# Altium schematic sheet SOC_PL_Banks_63_64_65_DDR4.SchDoc: Title
size 420 x 297 mm; Author: G.Kasprowicz; CompanyName: WUT ISE; DrawnBy: G.Kasprowicz; Organization: WUT ISE; Address1: PW ISE; Address2: Nowowiejska 15/19 00-665 Warsaw; Address3: gkasprow@gmail.com; DocumentNumber: 15; Revision: 2; SheetNumber: 15; SheetTotal: 40; ModifiedBy: -; CheckedDate: -; Title2: Title 2; DivGrp: WUT ISE; Designer: G.Kasprowicz; ModifiedDate: -; ProjectName: Sensor Box
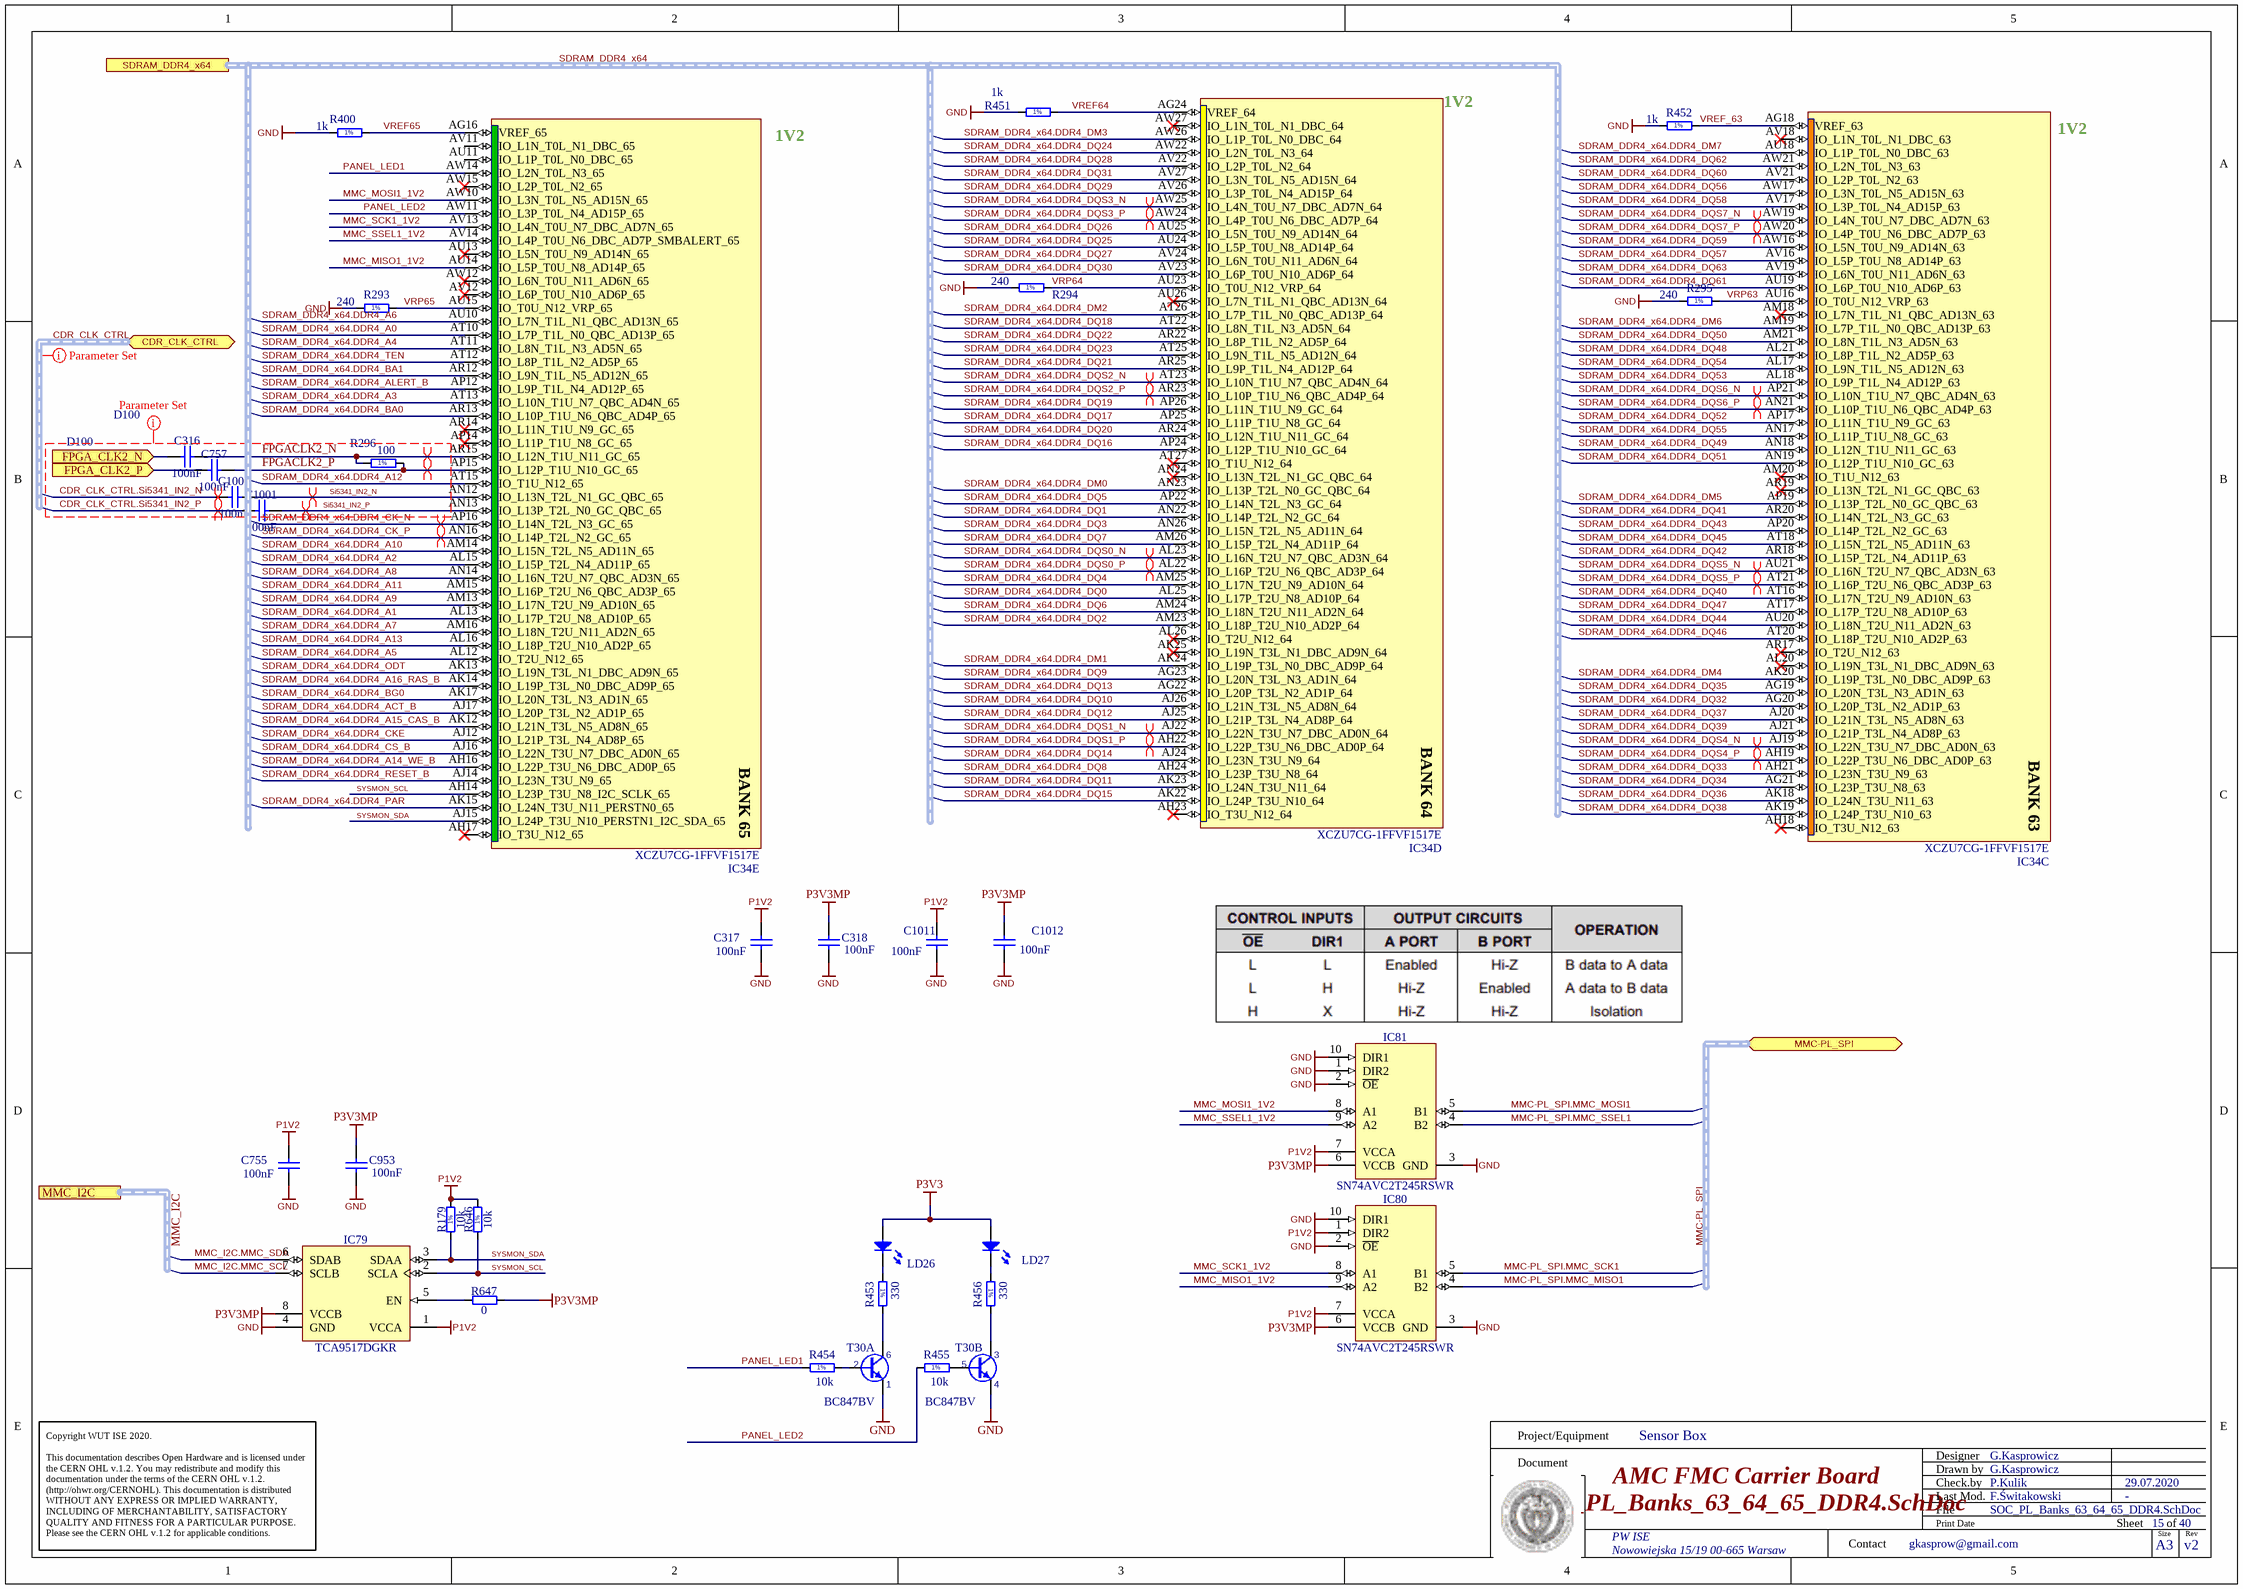
[diagram p0: SOC_PL_Banks_63_64_65_DDR4.SchDoc]

## Parts
C316  100nF  [CAPC0603X33N]
C317  100nF  [CAPC0603X33N]
C318  100nF  [CAPC0603X33N]
C755  100nF  [CAPC0603X33N]
C757  100nF  [CAPC0603X33N]
C953  100nF  [CAPC0603X33N]
C1000  100nF  [CAPC0603X33N]
C1001  100nF  [CAPC0603X33N]
C1011  100nF  [CAPC0603X33N]
C1012  100nF  [CAPC0603X33N]
IC34  XCZU7CG-1FFVF1517E  [BGA1517C100P39X39_4000X4000X351]  (parts C,D,E of 28)
IC79  TCA9517DGKR  [SOP65P490X110-8N]
IC80  SN74AVC2T245RSWR  [QFN40P140X180X55-10N]
IC81  SN74AVC2T245RSWR  [QFN40P140X180X55-10N]
LD26  Green  [LED_AVAGO_HSME-C120]  (value not drawn)
LD27  Green  [LED_AVAGO_HSME-C120]  (value not drawn)
R179  10k  [RESC1005X40N]
R293  240  [RESC1005X40N]
R294  240  [RESC1005X40N]
R295  240  [RESC1005X40N]
R296  100  [RESC1005X40N]
R400  1k  [RESC1005X40N]
R451  1k  [RESC1005X40N]
R452  1k  [RESC1005X40N]
R453  330  [RESC1005X40N]
R454  10k  [RESC1005X40N]
R455  10k  [RESC1005X40N]
R456  330  [RESC1005X40N]
R646  10k  [RESC1005X40N]
R647  0  [RESC1005X40N]
T30  BC847BV  [SOTFL50P160X60-6N]  (parts A,B of 2)

## Ports
CDR_CLK_CTRL (bidir, harness CDR_CLK_CTRL), FPGA_CLK2_N (in), FPGA_CLK2_P (in), MMC-PL_SPI (bidir, harness MMC-PL_SPI), MMC_I2C (harness MMC_I2C), SDRAM_DDR4_x64 (harness SDRAM_DDR4_x64)

## Nets
GND: C317.1 C318.1 C755.1 C953.1 C1011.1 C1012.1 IC79.4(GND) IC80.2(~{OE}) IC80.3(GND) IC80.10(DIR1) IC81.1(DIR2) IC81.2(~{OE}) IC81.3(GND) IC81.10(DIR1) R293.1 R294.1 R295.1 R400.1 R451.1 R452.1 T30.1(E) T30.4(E)
P1V2: C317.2 C755.2 C1011.2 IC79.1(VCCA) IC80.1(DIR2) IC80.7(VCCA) IC81.7(VCCA) R179.2 R646.2
P3V3: LD26.2(A) LD27.2(A)
P3V3MP: C318.2 C953.2 C1012.2 IC79.8(VCCB) IC80.6(VCCB) IC81.6(VCCB) R647.2
CDR_CLK_CTRL.Si5341_IN2_N: C1000.1
CDR_CLK_CTRL.Si5341_IN2_P: C1001.1
FPGA_CLK2_N: C316.1 ; port FPGA_CLK2_N
FPGA_CLK2_P: C757.1 ; port FPGA_CLK2_P
FPGACLK2_N: C316.2 IC34.AR15(IO_L12N_T1U_N11_GC_65) R296.1
FPGACLK2_P: C757.2 IC34.AP15(IO_L12P_T1U_N10_GC_65) R296.2
MMC-PL_SPI.MMC_MISO1: IC80.4(B2)
MMC-PL_SPI.MMC_MOSI1: IC81.5(B1)
MMC-PL_SPI.MMC_SCK1: IC80.5(B1)
MMC-PL_SPI.MMC_SSEL1: IC81.4(B2)
MMC_I2C.MMC_SCL: IC79.7(SCLB)
MMC_I2C.MMC_SDA: IC79.6(SDAB)
MMC_MISO1_1V2: IC34.AU14(IO_L5P_T0U_N8_AD14P_65) IC80.9(A2)
MMC_MOSI1_1V2: IC34.AW10(IO_L3N_T0L_N5_AD15N_65) IC81.8(A1)
MMC_SCK1_1V2: IC34.AV13(IO_L4N_T0U_N7_DBC_AD7N_65) IC80.8(A1)
MMC_SSEL1_1V2: IC34.AV14(IO_L4P_T0U_N6_DBC_AD7P_SMBALERT_65) IC81.9(A2)
PANEL_LED1: IC34.AW14(IO_L2N_T0L_N3_65) R454.1
PANEL_LED2: IC34.AW11(IO_L3P_T0L_N4_AD15P_65) R455.1
SDRAM_DDR4_x64.DDR4_A0: IC34.AT10(IO_L7P_T1L_N0_QBC_AD13P_65)
SDRAM_DDR4_x64.DDR4_A1: IC34.AL13(IO_L17P_T2U_N8_AD10P_65)
SDRAM_DDR4_x64.DDR4_A2: IC34.AL15(IO_L15P_T2L_N4_AD11P_65)
SDRAM_DDR4_x64.DDR4_A3: IC34.AT13(IO_L10N_T1U_N7_QBC_AD4N_65)
SDRAM_DDR4_x64.DDR4_A4: IC34.AT11(IO_L8N_T1L_N3_AD5N_65)
SDRAM_DDR4_x64.DDR4_A5: IC34.AL12(IO_T2U_N12_65)
SDRAM_DDR4_x64.DDR4_A6: IC34.AU10(IO_L7N_T1L_N1_QBC_AD13N_65)
SDRAM_DDR4_x64.DDR4_A7: IC34.AM16(IO_L18N_T2U_N11_AD2N_65)
SDRAM_DDR4_x64.DDR4_A8: IC34.AN14(IO_L16N_T2U_N7_QBC_AD3N_65)
SDRAM_DDR4_x64.DDR4_A9: IC34.AM13(IO_L17N_T2U_N9_AD10N_65)
SDRAM_DDR4_x64.DDR4_A10: IC34.AM14(IO_L15N_T2L_N5_AD11N_65)
SDRAM_DDR4_x64.DDR4_A11: IC34.AM15(IO_L16P_T2U_N6_QBC_AD3P_65)
SDRAM_DDR4_x64.DDR4_A12: IC34.AT15(IO_T1U_N12_65)
SDRAM_DDR4_x64.DDR4_A13: IC34.AL16(IO_L18P_T2U_N10_AD2P_65)
SDRAM_DDR4_x64.DDR4_A14_WE_B: IC34.AH16(IO_L22P_T3U_N6_DBC_AD0P_65)
SDRAM_DDR4_x64.DDR4_A15_CAS_B: IC34.AK12(IO_L21N_T3L_N5_AD8N_65)
SDRAM_DDR4_x64.DDR4_A16_RAS_B: IC34.AK14(IO_L19P_T3L_N0_DBC_AD9P_65)
SDRAM_DDR4_x64.DDR4_ACT_B: IC34.AJ17(IO_L20P_T3L_N2_AD1P_65)
SDRAM_DDR4_x64.DDR4_ALERT_B: IC34.AP12(IO_L9P_T1L_N4_AD12P_65)
SDRAM_DDR4_x64.DDR4_BA0: IC34.AR13(IO_L10P_T1U_N6_QBC_AD4P_65)
SDRAM_DDR4_x64.DDR4_BA1: IC34.AR12(IO_L9N_T1L_N5_AD12N_65)
SDRAM_DDR4_x64.DDR4_BG0: IC34.AK17(IO_L20N_T3L_N3_AD1N_65)
SDRAM_DDR4_x64.DDR4_CK_N: IC34.AP16(IO_L14N_T2L_N3_GC_65)
SDRAM_DDR4_x64.DDR4_CK_P: IC34.AN16(IO_L14P_T2L_N2_GC_65)
SDRAM_DDR4_x64.DDR4_CKE: IC34.AJ12(IO_L21P_T3L_N4_AD8P_65)
SDRAM_DDR4_x64.DDR4_CS_B: IC34.AJ16(IO_L22N_T3U_N7_DBC_AD0N_65)
SDRAM_DDR4_x64.DDR4_DM0: IC34.AN23(IO_L13P_T2L_N0_GC_QBC_64)
SDRAM_DDR4_x64.DDR4_DM1: IC34.AK24(IO_L19P_T3L_N0_DBC_AD9P_64)
SDRAM_DDR4_x64.DDR4_DM2: IC34.AT26(IO_L7P_T1L_N0_QBC_AD13P_64)
SDRAM_DDR4_x64.DDR4_DM3: IC34.AW26(IO_L1P_T0L_N0_DBC_64)
SDRAM_DDR4_x64.DDR4_DM4: IC34.AK20(IO_L19P_T3L_N0_DBC_AD9P_63)
SDRAM_DDR4_x64.DDR4_DM5: IC34.AP19(IO_L13P_T2L_N0_GC_QBC_63)
SDRAM_DDR4_x64.DDR4_DM6: IC34.AM19(IO_L7P_T1L_N0_QBC_AD13P_63)
SDRAM_DDR4_x64.DDR4_DM7: IC34.AU18(IO_L1P_T0L_N0_DBC_63)
SDRAM_DDR4_x64.DDR4_DQ0: IC34.AL25(IO_L17P_T2U_N8_AD10P_64)
SDRAM_DDR4_x64.DDR4_DQ1: IC34.AN22(IO_L14P_T2L_N2_GC_64)
SDRAM_DDR4_x64.DDR4_DQ2: IC34.AM23(IO_L18P_T2U_N10_AD2P_64)
SDRAM_DDR4_x64.DDR4_DQ3: IC34.AN26(IO_L15N_T2L_N5_AD11N_64)
SDRAM_DDR4_x64.DDR4_DQ4: IC34.AM25(IO_L17N_T2U_N9_AD10N_64)
SDRAM_DDR4_x64.DDR4_DQ5: IC34.AP22(IO_L14N_T2L_N3_GC_64)
SDRAM_DDR4_x64.DDR4_DQ6: IC34.AM24(IO_L18N_T2U_N11_AD2N_64)
SDRAM_DDR4_x64.DDR4_DQ7: IC34.AM26(IO_L15P_T2L_N4_AD11P_64)
SDRAM_DDR4_x64.DDR4_DQ8: IC34.AH24(IO_L23P_T3U_N8_64)
SDRAM_DDR4_x64.DDR4_DQ9: IC34.AG23(IO_L20N_T3L_N3_AD1N_64)
SDRAM_DDR4_x64.DDR4_DQ10: IC34.AJ26(IO_L21N_T3L_N5_AD8N_64)
SDRAM_DDR4_x64.DDR4_DQ11: IC34.AK23(IO_L24N_T3U_N11_64)
SDRAM_DDR4_x64.DDR4_DQ12: IC34.AJ25(IO_L21P_T3L_N4_AD8P_64)
SDRAM_DDR4_x64.DDR4_DQ13: IC34.AG22(IO_L20P_T3L_N2_AD1P_64)
SDRAM_DDR4_x64.DDR4_DQ14: IC34.AJ24(IO_L23N_T3U_N9_64)
SDRAM_DDR4_x64.DDR4_DQ15: IC34.AK22(IO_L24P_T3U_N10_64)
SDRAM_DDR4_x64.DDR4_DQ16: IC34.AP24(IO_L12P_T1U_N10_GC_64)
SDRAM_DDR4_x64.DDR4_DQ17: IC34.AP25(IO_L11P_T1U_N8_GC_64)
SDRAM_DDR4_x64.DDR4_DQ18: IC34.AT22(IO_L8N_T1L_N3_AD5N_64)
SDRAM_DDR4_x64.DDR4_DQ19: IC34.AP26(IO_L11N_T1U_N9_GC_64)
SDRAM_DDR4_x64.DDR4_DQ20: IC34.AR24(IO_L12N_T1U_N11_GC_64)
SDRAM_DDR4_x64.DDR4_DQ21: IC34.AR25(IO_L9P_T1L_N4_AD12P_64)
SDRAM_DDR4_x64.DDR4_DQ22: IC34.AR22(IO_L8P_T1L_N2_AD5P_64)
SDRAM_DDR4_x64.DDR4_DQ23: IC34.AT25(IO_L9N_T1L_N5_AD12N_64)
SDRAM_DDR4_x64.DDR4_DQ24: IC34.AW22(IO_L2N_T0L_N3_64)
SDRAM_DDR4_x64.DDR4_DQ25: IC34.AU24(IO_L5P_T0U_N8_AD14P_64)
SDRAM_DDR4_x64.DDR4_DQ26: IC34.AU25(IO_L5N_T0U_N9_AD14N_64)
SDRAM_DDR4_x64.DDR4_DQ27: IC34.AV24(IO_L6N_T0U_N11_AD6N_64)
SDRAM_DDR4_x64.DDR4_DQ28: IC34.AV22(IO_L2P_T0L_N2_64)
SDRAM_DDR4_x64.DDR4_DQ29: IC34.AV26(IO_L3P_T0L_N4_AD15P_64)
SDRAM_DDR4_x64.DDR4_DQ30: IC34.AV23(IO_L6P_T0U_N10_AD6P_64)
SDRAM_DDR4_x64.DDR4_DQ31: IC34.AV27(IO_L3N_T0L_N5_AD15N_64)
SDRAM_DDR4_x64.DDR4_DQ32: IC34.AG20(IO_L20P_T3L_N2_AD1P_63)
SDRAM_DDR4_x64.DDR4_DQ33: IC34.AH21(IO_L23N_T3U_N9_63)
SDRAM_DDR4_x64.DDR4_DQ34: IC34.AG21(IO_L23P_T3U_N8_63)
SDRAM_DDR4_x64.DDR4_DQ35: IC34.AG19(IO_L20N_T3L_N3_AD1N_63)
SDRAM_DDR4_x64.DDR4_DQ36: IC34.AK18(IO_L24N_T3U_N11_63)
SDRAM_DDR4_x64.DDR4_DQ37: IC34.AJ20(IO_L21N_T3L_N5_AD8N_63)
SDRAM_DDR4_x64.DDR4_DQ38: IC34.AK19(IO_L24P_T3U_N10_63)
SDRAM_DDR4_x64.DDR4_DQ39: IC34.AJ21(IO_L21P_T3L_N4_AD8P_63)
SDRAM_DDR4_x64.DDR4_DQ40: IC34.AT16(IO_L17N_T2U_N9_AD10N_63)
SDRAM_DDR4_x64.DDR4_DQ41: IC34.AR20(IO_L14N_T2L_N3_GC_63)
SDRAM_DDR4_x64.DDR4_DQ42: IC34.AR18(IO_L15P_T2L_N4_AD11P_63)
SDRAM_DDR4_x64.DDR4_DQ43: IC34.AP20(IO_L14P_T2L_N2_GC_63)
SDRAM_DDR4_x64.DDR4_DQ44: IC34.AU20(IO_L18N_T2U_N11_AD2N_63)
SDRAM_DDR4_x64.DDR4_DQ45: IC34.AT18(IO_L15N_T2L_N5_AD11N_63)
SDRAM_DDR4_x64.DDR4_DQ46: IC34.AT20(IO_L18P_T2U_N10_AD2P_63)
SDRAM_DDR4_x64.DDR4_DQ47: IC34.AT17(IO_L17P_T2U_N8_AD10P_63)
SDRAM_DDR4_x64.DDR4_DQ48: IC34.AL21(IO_L8P_T1L_N2_AD5P_63)
SDRAM_DDR4_x64.DDR4_DQ49: IC34.AN18(IO_L12N_T1U_N11_GC_63)
SDRAM_DDR4_x64.DDR4_DQ50: IC34.AM21(IO_L8N_T1L_N3_AD5N_63)
SDRAM_DDR4_x64.DDR4_DQ51: IC34.AN19(IO_L12P_T1U_N10_GC_63)
SDRAM_DDR4_x64.DDR4_DQ52: IC34.AP17(IO_L11N_T1U_N9_GC_63)
SDRAM_DDR4_x64.DDR4_DQ53: IC34.AL18(IO_L9P_T1L_N4_AD12P_63)
SDRAM_DDR4_x64.DDR4_DQ54: IC34.AL17(IO_L9N_T1L_N5_AD12N_63)
SDRAM_DDR4_x64.DDR4_DQ55: IC34.AN17(IO_L11P_T1U_N8_GC_63)
SDRAM_DDR4_x64.DDR4_DQ56: IC34.AW17(IO_L3N_T0L_N5_AD15N_63)
SDRAM_DDR4_x64.DDR4_DQ57: IC34.AV16(IO_L5P_T0U_N8_AD14P_63)
SDRAM_DDR4_x64.DDR4_DQ58: IC34.AV17(IO_L3P_T0L_N4_AD15P_63)
SDRAM_DDR4_x64.DDR4_DQ59: IC34.AW16(IO_L5N_T0U_N9_AD14N_63)
SDRAM_DDR4_x64.DDR4_DQ60: IC34.AV21(IO_L2P_T0L_N2_63)
SDRAM_DDR4_x64.DDR4_DQ61: IC34.AU19(IO_L6P_T0U_N10_AD6P_63)
SDRAM_DDR4_x64.DDR4_DQ62: IC34.AW21(IO_L2N_T0L_N3_63)
SDRAM_DDR4_x64.DDR4_DQ63: IC34.AV19(IO_L6N_T0U_N11_AD6N_63)
SDRAM_DDR4_x64.DDR4_DQS0_N: IC34.AL23(IO_L16N_T2U_N7_QBC_AD3N_64)
SDRAM_DDR4_x64.DDR4_DQS0_P: IC34.AL22(IO_L16P_T2U_N6_QBC_AD3P_64)
SDRAM_DDR4_x64.DDR4_DQS1_N: IC34.AJ22(IO_L22N_T3U_N7_DBC_AD0N_64)
SDRAM_DDR4_x64.DDR4_DQS1_P: IC34.AH22(IO_L22P_T3U_N6_DBC_AD0P_64)
SDRAM_DDR4_x64.DDR4_DQS2_N: IC34.AT23(IO_L10N_T1U_N7_QBC_AD4N_64)
SDRAM_DDR4_x64.DDR4_DQS2_P: IC34.AR23(IO_L10P_T1U_N6_QBC_AD4P_64)
SDRAM_DDR4_x64.DDR4_DQS3_N: IC34.AW25(IO_L4N_T0U_N7_DBC_AD7N_64)
SDRAM_DDR4_x64.DDR4_DQS3_P: IC34.AW24(IO_L4P_T0U_N6_DBC_AD7P_64)
SDRAM_DDR4_x64.DDR4_DQS4_N: IC34.AJ19(IO_L22N_T3U_N7_DBC_AD0N_63)
SDRAM_DDR4_x64.DDR4_DQS4_P: IC34.AH19(IO_L22P_T3U_N6_DBC_AD0P_63)
SDRAM_DDR4_x64.DDR4_DQS5_N: IC34.AU21(IO_L16N_T2U_N7_QBC_AD3N_63)
SDRAM_DDR4_x64.DDR4_DQS5_P: IC34.AT21(IO_L16P_T2U_N6_QBC_AD3P_63)
SDRAM_DDR4_x64.DDR4_DQS6_N: IC34.AP21(IO_L10N_T1U_N7_QBC_AD4N_63)
SDRAM_DDR4_x64.DDR4_DQS6_P: IC34.AN21(IO_L10P_T1U_N6_QBC_AD4P_63)
SDRAM_DDR4_x64.DDR4_DQS7_N: IC34.AW19(IO_L4N_T0U_N7_DBC_AD7N_63)
SDRAM_DDR4_x64.DDR4_DQS7_P: IC34.AW20(IO_L4P_T0U_N6_DBC_AD7P_63)
SDRAM_DDR4_x64.DDR4_ODT: IC34.AK13(IO_L19N_T3L_N1_DBC_AD9N_65)
SDRAM_DDR4_x64.DDR4_PAR: IC34.AK15(IO_L24N_T3U_N11_PERSTN0_65)
SDRAM_DDR4_x64.DDR4_RESET_B: IC34.AJ14(IO_L23N_T3U_N9_65)
SDRAM_DDR4_x64.DDR4_TEN: IC34.AT12(IO_L8P_T1L_N2_AD5P_65)
Si5341_IN2_N: C1000.2 IC34.AN12(IO_L13N_T2L_N1_GC_QBC_65)
Si5341_IN2_P: C1001.2 IC34.AN13(IO_L13P_T2L_N0_GC_QBC_65)
SYSMON_SCL: IC34.AH14(IO_L23P_T3U_N8_I2C_SCLK_65) IC79.2(SCLA) R646.1
SYSMON_SDA: IC34.AJ15(IO_L24P_T3U_N10_PERSTN1_I2C_SDA_65) IC79.3(SDAA) R179.1
VREF64: IC34.AG24(VREF_64) R451.2
VREF65: IC34.AG16(VREF_65) R400.2
VREF_63: IC34.AG18(VREF_63) R452.2
VRP63: IC34.AU16(IO_T0U_N12_VRP_63) R295.2
VRP64: IC34.AU23(IO_T0U_N12_VRP_64) R294.2
VRP65: IC34.AU15(IO_T0U_N12_VRP_65) R293.2
NetIC79_5: IC79.5(EN) R647.1
NetLD26_1: LD26.1(C) R453.1
NetLD27_1: LD27.1(C) R456.1
NetR453_2: R453.2 T30.6(C)
NetR454_2: R454.2 T30.2(B)
NetR455_2: R455.2 T30.5(B)
NetR456_2: R456.2 T30.3(C)

Not connected (* = marked no-connect by the designer): IC34 AH17(IO_T3U_N12_65)* AH18(IO_T3U_N12_63)* AH23(IO_T3U_N12_64)* AK25(IO_L19N_T3L_N1_DBC_AD9N_64)* AL20(IO_L19N_T3L_N1_DBC_AD9N_63)* AL26(IO_T2U_N12_64)* AM18(IO_L7N_T1L_N1_QBC_AD13N_63)* AM20(IO_T1U_N12_63)* AN24(IO_L13N_T2L_N1_GC_QBC_64)* AP14(IO_L11P_T1U_N8_GC_65)* AR14(IO_L11N_T1U_N9_GC_65)* AR17(IO_T2U_N12_63)* AR19(IO_L13N_T2L_N1_GC_QBC_63)* AT27(IO_T1U_N12_64)* AU11(IO_L1P_T0L_N0_DBC_65) AU13(IO_L5N_T0U_N9_AD14N_65)* AU26(IO_L7N_T1L_N1_QBC_AD13N_64)* AV11(IO_L1N_T0L_N1_DBC_65) AV12(IO_L6P_T0U_N10_AD6P_65)* AV18(IO_L1N_T0L_N1_DBC_63)* AW12(IO_L6N_T0U_N11_AD6N_65)* AW15(IO_L2P_T0L_N2_65)* AW27(IO_L1N_T0L_N1_DBC_64)*

## Buses and harness runs
harness CDR_CLK_CTRL = port CDR_CLK_CTRL
harness MMC-PL_SPI = port MMC-PL_SPI
harness MMC_I2C = port MMC_I2C
harness SDRAM_DDR4_x64 = port SDRAM_DDR4_x64

## Layout directives
differential pair: CDR_CLK_CTRL.Si5341_IN2_N, CDR_CLK_CTRL.Si5341_IN2_P, FPGACLK2_N, FPGACLK2_P, SDRAM_DDR4_x64.DDR4_CK_N, SDRAM_DDR4_x64.DDR4_CK_P, SDRAM_DDR4_x64.DDR4_DQS0_N, SDRAM_DDR4_x64.DDR4_DQS0_P, SDRAM_DDR4_x64.DDR4_DQS1_N, SDRAM_DDR4_x64.DDR4_DQS1_P, SDRAM_DDR4_x64.DDR4_DQS2_N, SDRAM_DDR4_x64.DDR4_DQS2_P, SDRAM_DDR4_x64.DDR4_DQS3_N, SDRAM_DDR4_x64.DDR4_DQS3_P, SDRAM_DDR4_x64.DDR4_DQS4_N, SDRAM_DDR4_x64.DDR4_DQS4_P, SDRAM_DDR4_x64.DDR4_DQS5_N, SDRAM_DDR4_x64.DDR4_DQS5_P, SDRAM_DDR4_x64.DDR4_DQS6_N, SDRAM_DDR4_x64.DDR4_DQS6_P, SDRAM_DDR4_x64.DDR4_DQS7_N, SDRAM_DDR4_x64.DDR4_DQS7_P, Si5341_IN2_N, Si5341_IN2_P
net class D100: (no net found under the mark), CDR_CLK_CTRL.Si5341_IN2_N, CDR_CLK_CTRL.Si5341_IN2_P, FPGACLK2_N, FPGACLK2_P, SDRAM_DDR4_x64.DDR4_A12, Si5341_IN2_N, Si5341_IN2_P

## Notes on the sheet
- 1V2
- Project/Equipment
- Document
- AMC FMC Carrier Board
- Designer
- Drawn by
- Check.by
- P.Kulik
- 29.07.2020
- Copyright WUT ISE 2020.
  This documentation describes Open Hardware and is licensed under the CERN OHL v.1.2. You may redistribute and modify this documentation under the terms of the CERN OHL v.1.2. (http://ohwr.org/CERNOHL). This documentation is distributed WITHOUT ANY EXPRESS OR IMPLIED WARRANTY, INCLUDING OF MERCHANTABILITY, SATISFACTORY QUALITY AND FITNESS FOR A PARTICULAR PURPOSE. Please see the CERN OHL v.1.2 for applicable conditions.
- Contact
- File
- Last Mod.
- Print Date
- F.Świtakowski
- Sheet
- Size
- A3
- of
- v2
- Rev
- (in symbol R0402_1K_1%_0.0625W_100PPM) 1%
- (in symbol R0402_10K_1%_0.0625W_100PPM) 1%
- (in symbol R0402_100R_1%_0.1W_100PPM) 1%
- (in symbol R0402_240R_1%_0.0625W_100PPM) 1%
- (in symbol R0402_330R_1%_0.0625W_100PPM) 1%
- (in symbol XCZU7CG-1FFVF1517E, part C) BANK 63
- (in symbol XCZU7CG-1FFVF1517E, part D) BANK 64
- (in symbol XCZU7CG-1FFVF1517E, part E) BANK 65

## Library data of the parts
C316 C757 C1000 C1001 = CC0201_100NF_6.3V_10%_X5R: Non-polarised capacitor; Part Description: SMD Multilayer Chip Ceramic Capacitor; Manufacturer: GENERIC; Manufacturer1 Part Number: 02016D104KAT2A; Voltage: 6.3V; TC: X5R; Tolerance: ±10%; Part Number: CC0201_100NF_6.3V_10%_X5R; Component Kind: Standard; Component Type: Standard; Pin Count: 2; Value: 100nF; Status: Not Recommended; Manufacturer Part Number: CC0201_100NF_6.3V_10%_X5R; Case: 0201; Mounted: Yes; Socket: No; SMD: Yes; Sense: No; Manufacturer1 Example: AVX; Manufacturer1 ComponentHeight: 0.33mm; HelpURL: \\cern.ch\dfs\Applications\Altium\Datasheets\CC0201_X5R_AVX.pdf; Author: CERN DEM JLC; CreateDate: 03.12.2007; LatestRevisionDate: 03.12.2007
C317 C318 C755 C953 C1011 C1012 = CC0201_100NF_6.3V_10%_X5R: Non-polarised capacitor; Manufacturer: GENERIC; Manufacturer1 Part Number: 02016D104KAT2A; Part Description: SMD Multilayer Chip Ceramic Capacitor; TC: X5R; Tolerance: ±10%; Voltage: 6.3V; Author: CERN DEM JLC; Case: 0201; Component Kind: Standard; Component Type: Standard; CreateDate: 03/12/2007; HelpURL: \\cern.ch\dfs\Applications\Altium\Datasheets\CC0201_X5R_AVX.pdf; LatestRevisionDate: 03/12/2007; Manufacturer Part Number: CC0201_100NF_6.3V_10%_X5R; Manufacturer1 ComponentHeight: 0.33mm; Manufacturer1 Example: AVX; Mounted: Yes; Part Number: CC0201_100NF_6.3V_10%_X5R; Pin Count: 2; SMD: Yes; Socket: No; Status: Not Recommended; Value: 100nF; Sense: No
IC34 = XCZU7CG-1FFVF1517E: Zynq UltraScale+ RFSoC, Quad-Core ARM® Cortex™-A53 MPCore™ up to 1.5GHz, 214 PS I/O, 416 HP I/O, 48 HD I/O, 1517-Pin BGA; Part Description: Zynq UltraScale+ MPSoC, Quad-Core ARM® Cortex™-A53 MPCore™ up to 1.5GHz, 214 PS I/O, 416 HP I/O, 48 HD I/O, 1517-Pin BGA; Manufacturer: XILINX; PressFit: No; Bonding: No; Part Number: XCZU7CG-1FFVF1517E; Component Kind: Standard; Component Type: Standard; Device: XCZU7CG-1FFVF1517E; PackageDescription: BGA, 1.00mm Pitch, Square; 1517 Pin, 39 Columns X 39 Rows, Body 40.00mm X 40.00mm X 3.51mm H, IPC Medium Density; Manufacturer Part Number: XCZU7CG-1FFVF1517E; Pin Count: 1517; Case: BGA1517; Mounted: Yes; Socket: No; SMD: Yes; Sense: No; ComponentHeight: 3.51mm; HelpURL: \\cern.ch\dfs\Applications\Altium\Datasheets\XCZU7CG-1FFVF1517E.pdf; ComponentLink1URL: \\cern.ch\dfs\Applications\Altium\Datasheets\XCZU7CG-1FFVF1517E_Package-Pinout.pdf; ComponentLink1Description: Package/Pinout; ComponentLink2URL: \\cern.ch\dfs\Applications\Altium\Datasheets\XCZU7CG-1FFVF1517E_Pinout.pdf; ComponentLink2Description: Pinout; Author: CERN DEM BC; CreateDate: 10.07.2019; LatestRevisionDate: 10.07.2019
IC79 = TCA9517DGKR: Level-Translating I2C Bus Repeater; Manufacturer: TEXAS INSTRUMENTS; PressFit: No; Bonding: No; Part Number: TCA9517DGKR; Component Kind: Standard; Component Type: Standard; Device: TCA9517DGKR; PackageDescription: SOP, 0.65mm Pitch; 8 Pin, 3.00mm W X 3.00mm L X 1.10mm H body, IPC Medium Density; Part Description: Level-Translating I2C Bus Repeater; Manufacturer Part Number: TCA9517DGKR; Pin Count: 8; Case: TSSOP8; Mounted: Yes; Socket: No; SMD: Yes; Sense: No; ComponentHeight: 1.1mm; Author: CERN DEM JLC; HelpURL: \\cern.ch\dfs\Applications\Altium\Datasheets\TCA9517DGKR.pdf; CreateDate: 07.07.2014; LatestRevisionDate: 07.07.2014
IC80 IC81 = SN74AVC2T245RSWR: Dual-Bit Dual-Supply Bus Transceiver With Configurable Voltage Translation and 3-State Outputs; Manufacturer: TEXAS INSTRUMENTS; PressFit: No; Bonding: No; Manufacturer Part Number: SN74AVC2T245RSWR; PackageDescription: QFN, 0.40mm Pitch, Rect.;10 Pin, 1.80mm L X 1.40mm W X 0.55mm H Body, IPC Medium Density; Part Description: Dual-Bit Dual-Supply Bus Transceiver With Configurable Voltage Translation and 3-State Outputs; Part Number: SN74AVC2T245RSWR; Component Kind: Standard; Component Type: Standard; Device: SN74AVC2T245RSWR; Status: Not Recommended; Pin Count: 10; Case: QFN10; Mounted: Yes; Socket: No; SMD: Yes; Sense: No; ComponentHeight: 0.55mm; Author: CERN DEM JLC; HelpURL: \\cern.ch\dfs\Applications\Altium\Datasheets\SN74AVC2T245RSWR.pdf; CreateDate: 07.07.2014; LatestRevisionDate: 30.03.2017
LD26 LD27 = LED_AVAGO_HSME-C120: LED Green 1C 2A; Manufacturer: AVAGO TECHNOLOGIES; Part Description: High Performance Right Angle Chip Green LED; PressFit: No; Bonding: No; Manufacturer Part Number: HSME-C120; PackageDescription: Green Chip LED, 2-Leads, Body 1.7x1.1mm, Side Emitting Package; Part Number: LED_AVAGO_HSME-C120; Component Kind: Standard; Component Type: Standard; Color: Green; Pin Count: 2; Mounted: Yes; Socket: No; SMD: Yes; Sense: No; ComponentHeight: 0.7mm; HelpURL: \\cern.ch\dfs\Applications\Altium\Datasheets\LED_AVAGO_HSME-C120.pdf; ComponentLink1URL: \\cern.ch\dfs\Applications\Altium\Datasheets\LED_AVAGO_HSME-C110_DESIGN-GUIDE.pdf; ComponentLink1Description: Design Guide; Author: CERN DEM JMW; CreateDate: 22.07.2009; LatestRevisionDate: 20.06.2012
R179 R646 = R0402_10K_1%_0.0625W_100PPM: Resistor - 1%; Part Description: General Purpose Thick Film Chip Resistor; Manufacturer: GENERIC; Manufacturer1 Part Number: 232270671003L; TC: ±100ppm/°C; PressFit: No; Part Number: R0402_10K_1%_0.0625W_100PPM; Component Kind: Standard; Component Type: Standard; Pin Count: 2; Value: 10k; Status: Not Recommended; Power: 0.0625W; Tolerance: ±1%; Manufacturer Part Number: R0402_10K_1%_0.0625W_100PPM; Case: 0402; Mounted: Yes; Sense: No; Socket: No; SMD: Yes; Manufacturer1 Example: YAGEO PHYCOMP; Manufacturer1 ComponentHeight: 0.4mm; HelpURL: \\cern.ch\dfs\Applications\Altium\Datasheets\R0402_Phycomp_RC0402.pdf; Author: CERN DEM JLC; CreateDate: 03.12.2007; LatestRevisionDate: 17.10.2012
R293-R295 = R0402_240R_1%_0.0625W_100PPM: Resistor - 1%; Manufacturer: GENERIC; Part Description: General Purpose Thick Film Chip Resistor; Manufacturer1 Part Number: 232270672401L; TC: ±100ppm/°C; PressFit: No; Manufacturer Part Number: R0402_240R_1%_0.0625W_100PPM; Part Number: R0402_240R_1%_0.0625W_100PPM; Tolerance: ±1%; Value: 240; Component Kind: Standard; Component Type: Standard; Pin Count: 2; Status: Not Recommended; Power: 0.0625W; Case: 0402; Mounted: Yes; Sense: No; Socket: No; SMD: Yes; Manufacturer1 Example: YAGEO PHYCOMP; Manufacturer1 ComponentHeight: 0.4mm; HelpURL: \\cern.ch\dfs\Applications\Altium\Datasheets\R0402_Phycomp_RC0402.pdf; Author: CERN DEM JLC; CreateDate: 03/12/2007; LatestRevisionDate: 17/10/2012
R296 = R0402_100R_1%_0.1W_100PPM: Resistor - 1%; Manufacturer Part Number: R0402_100R_1%_0.1W_100PPM_50V; Manufacturer: GENERIC; Part Description: General Purpose Thick Film Chip Resistor; Manufacturer1 Part Number: ERJ2RKF1000X; Power: 0.1W; TC: ±100ppm/°C; Voltage: 50V; PressFit: No; Part Number: R0402_100R_1%_0.1W_100PPM; Tolerance: ±1%; Value: 100; Component Kind: Standard; Component Type: Standard; Pin Count: 2; Status: Not Recommended; Case: 0402; Mounted: Yes; Sense: No; Socket: No; SMD: Yes; Manufacturer1 Example: PANASONIC; Manufacturer1 ComponentHeight: 0.4mm; HelpURL: \\cern.ch\dfs\Applications\Altium\Datasheets\R0402_PANASONIC_ERJ2RK.pdf; Author: CERN DEM JLC; CreateDate: 12/12/2013; LatestRevisionDate: 03/03/2015
R400 R451 R452 = R0402_1K_1%_0.0625W_100PPM: Resistor - 1%; Manufacturer: GENERIC; Part Description: General Purpose Thick Film Chip Resistor; Manufacturer1 Part Number: 232270671002L; TC: ±100ppm/°C; PressFit: No; Manufacturer Part Number: R0402_1K_1%_0.0625W_100PPM; Part Number: R0402_1K_1%_0.0625W_100PPM; Tolerance: ±1%; Value: 1k; Component Kind: Standard; Component Type: Standard; Pin Count: 2; Status: Not Recommended; Power: 0.0625W; Case: 0402; Mounted: Yes; Sense: No; Socket: No; SMD: Yes; Manufacturer1 Example: YAGEO PHYCOMP; Manufacturer1 ComponentHeight: 0.4mm; HelpURL: \\cern.ch\dfs\Applications\Altium\Datasheets\R0402_Phycomp_RC0402.pdf; Author: CERN DEM JLC; CreateDate: 03/12/2007; LatestRevisionDate: 17/10/2012
R453 R456 = R0402_330R_1%_0.0625W_100PPM: Resistor - 1%; Manufacturer: GENERIC; Part Description: General Purpose Thick Film Chip Resistor; Manufacturer1 Part Number: 232270673301L; TC: ±100ppm/°C; PressFit: No; Manufacturer Part Number: R0402_330R_1%_0.0625W_100PPM; Part Number: R0402_330R_1%_0.0625W_100PPM; Tolerance: ±1%; Value: 330; Component Kind: Standard; Component Type: Standard; Pin Count: 2; Status: Not Recommended; Power: 0.0625W; Case: 0402; Mounted: Yes; Sense: No; Socket: No; SMD: Yes; Manufacturer1 Example: YAGEO PHYCOMP; Manufacturer1 ComponentHeight: 0.4mm; HelpURL: \\cern.ch\dfs\Applications\Altium\Datasheets\R0402_Phycomp_RC0402.pdf; Author: CERN DEM JLC; CreateDate: 03/12/2007; LatestRevisionDate: 17/10/2012
R454 R455 = R0402_10K_1%_0.0625W_100PPM: Resistor - 1%; Manufacturer: GENERIC; Part Description: General Purpose Thick Film Chip Resistor; Manufacturer1 Part Number: 232270671003L; TC: ±100ppm/°C; PressFit: No; Manufacturer Part Number: R0402_10K_1%_0.0625W_100PPM; Part Number: R0402_10K_1%_0.0625W_100PPM; Tolerance: ±1%; Value: 10k; Component Kind: Standard; Component Type: Standard; Pin Count: 2; Status: Not Recommended; Power: 0.0625W; Case: 0402; Mounted: Yes; Sense: No; Socket: No; SMD: Yes; Manufacturer1 Example: YAGEO PHYCOMP; Manufacturer1 ComponentHeight: 0.4mm; HelpURL: \\cern.ch\dfs\Applications\Altium\Datasheets\R0402_Phycomp_RC0402.pdf; Author: CERN DEM JLC; CreateDate: 03/12/2007; LatestRevisionDate: 17/10/2012
R647 = R0402_0R_JUMPER: Resistor; Part Description: 1A (0.05R Max DC Resistance) Zero Ohm Jumper; Manufacturer: GENERIC; Manufacturer1 Part Number: 232270591001L; PressFit: No; Part Number: R0402_0R_JUMPER; Component Kind: Standard; Component Type: Standard; Pin Count: 2; Value: 0; Status: Not Recommended; Manufacturer Part Number: R0402_0R_JUMPER; Case: 0402; Mounted: Yes; Sense: No; Socket: No; SMD: Yes; Manufacturer1 Example: YAGEO PHYCOMP; Manufacturer1 ComponentHeight: 0.4mm; HelpURL: \\cern.ch\dfs\Applications\Altium\Datasheets\R0402_Phycomp_RC0402.pdf; Author: CERN DEM JLC; CreateDate: 03.12.2007; LatestRevisionDate: 17.10.2012
T30 = BC847BV: 45V, 100mA NPN General Purpose Double Transistor; Manufacturer: NXP SEMICONDUCTORS; Part Description: 45V 100mA NPN General Purpose Double Transistor; PressFit: No; Bonding: No; Manufacturer Part Number: BC847BV; PackageDescription: SOTFL (SOT666), 0.50mm, Pitch; 6 Pin, 1.20mm W X 1.60mm L X 0.60mm H Body, IPC Medium Density; Part Number: BC847BV; Component Kind: Standard; Component Type: Standard; Device: BC847BV; Pin Count: 6; Case: SOT666; Mounted: Yes; Socket: No; SMD: Yes; Sense: No; ComponentHeight: 0.6mm; HelpURL: \\cern.ch\dfs\Applications\Altium\Datasheets\BC847BV.pdf; Author: CERN DEM JLC; CreateDate: 01.12.2011; LatestRevisionDate: 01.12.2011